# Altium schematic sheet GridSeed Old.SchDoc (part 2 of 2)
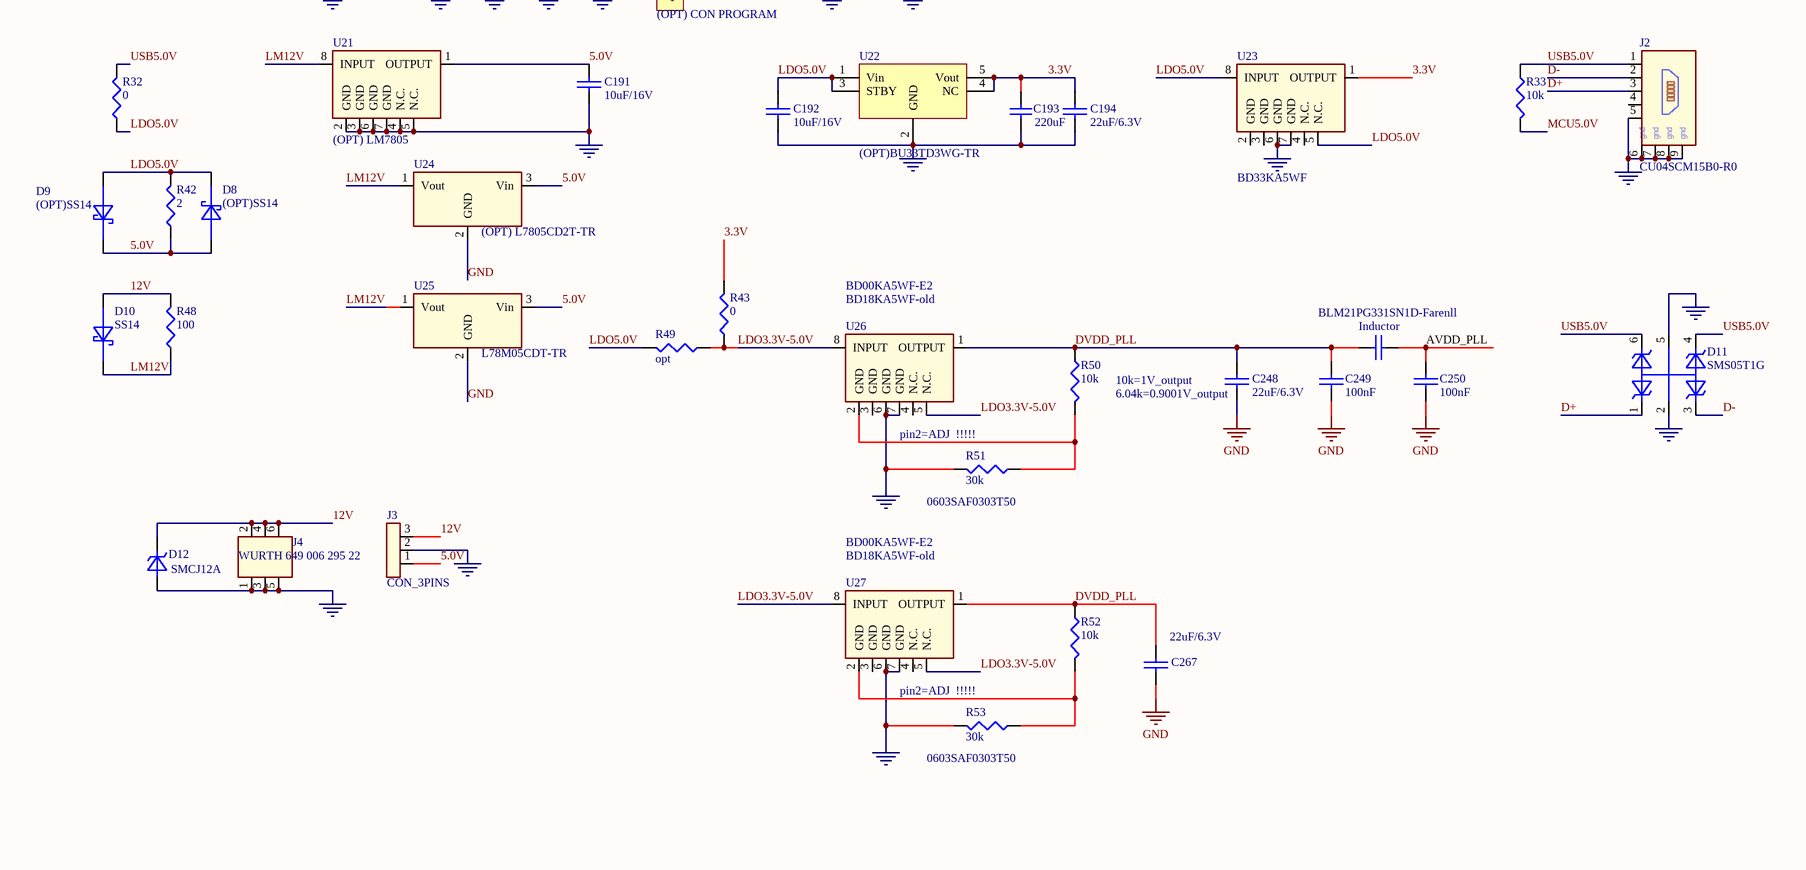
[diagram p6: GridSeed Old.SchDoc, bottom right]

## Nets
CHIP10_ID0: C1.1 C2.1 C3.1 C4.2 C5.2 C6.2 C10.2 C11.2 C12.2 C13.2 C14.2 C15.2 C16.2 C17.2 C18.2 C19.2 C20.2 C21.2 C22.2 C23.2 C24.2 C25.2 C26.2 C27.2 C28.2 C29.2 C30.2 C31.2 C32.2 C33.2 C34.2 C35.2 C36.2 C37.2 C38.2 C39.2 C40.2 C41.2 C42.2 C43.2 C44.2 C45.2 C46.2 C47.2 C48.2 C49.2 C50.2 C51.2 C52.2 C53.2 C54.2 C55.2 C56.2 C57.2 C58.2 C59.2 C60.2 C61.2 C62.2 C63.2 C64.2 C65.2 C66.2 C67.2 C68.2 C69.2 C70.2 C71.2 C72.2 C73.2 C74.2 C75.2 C76.2 C77.2 C78.2 C79.2 C80.2 C81.2 C82.2 C83.2 C84.2 C85.2 C86.2 C87.2 C88.2 C89.2 C90.2 C91.2 C92.2 C93.2 C94.2 C95.2 C96.2 C97.2 C98.2 C99.2 C100.2 C101.2 C102.2 C103.2 C104.2 C105.2 C106.2 C107.2 C108.2 C109.2 C110.2 C111.2 C112.2 C113.2 C114.2 C115.2 C116.2 C117.2 C118.2 C119.2 C120.2 C121.2 C122.2 C123.2 C124.2 C125.2 C126.2 C127.2 C128.2 C129.2 C130.2 C131.2 C132.2 C133.2 C134.2 C135.2 C136.2 C137.2 C138.2 C139.2 C140.2 C141.2 C142.2 C143.2 C144.2 C145.2 C146.2 C147.2 C148.2 C149.2 C150.2 C151.2 C152.2 C153.2 C154.2 C155.2 C156.2 C157.2 C158.2 C159.2 C160.2 C161.2 C162.2 C163.2 C164.2 C165.2 C166.2 C167.2 C168.2 C169.2 C170.2 C171.2 C172.2 C173.2 C174.2 C175.2 C176.2 C177.2 C178.2 C179.2 C180.2 C181.2 C182.2 C183.2 C184.2 C185.2 C186.2 C187.2 C188.2 C189.2 C190.2 C191.2 C192.2 C193.2 C194.2 C195.2 C196.2 C197.2 C198.2 C199.2 C200.2 C201.2 C202.2 C203.2 C204.2 C205.2 C206.2 C207.2 C208.2 C209.2 C210.2 C211.2 C212.2 C213.2 C214.2 C215.2 C216.2 C217.2 C218.2 C219.2 C220.2 C221.2 C222.2 C223.2 C224.2 C225.2 C226.2 C227.2 C228.2 C229.2 C230.2 C231.2 C232.2 C233.2 C234.2 C235.2 C236.2 C237.2 C238.2 C239.2 C240.2 C241.2 C242.2 C243.2 C244.2 C245.2 C246.2 C248.2 C249.2 C250.2 C251.2 C252.2 C253.2 C254.2 C255.2 C256.2 C257.2 C258.2 C259.2 C260.2 C261.2 C262.2 C263.2 C264.2 C265.2 C266.2 C267.2 C268.2 C269.2 C270.2 C271.2 C272.2 C273.2 C274.2 C275.2 C276.2 C277.2 C278.2 C279.2 C280.2 C281.2 C282.2 C283.2 C284.2 C285.2 C286.2 C287.2 C288.2 C289.2 C290.2 C291.2 C292.2 C293.2 C294.2 C295.2 C296.2 C297.2 C298.2 C299.2 C300.2 C301.2 C302.2 C303.2 C304.2 C305.2 C306.2 C307.2 C308.2 C309.2 C310.2 C311.2 C312.2 C313.2 C314.2 C315.2 C316.2 C317.2 C318.2 C319.2 C320.2 C321.2 C322.2 C323.2 C324.2 C325.2 C326.2 C327.2 C328.2 C329.2 C330.2 C331.2 C332.2 C333.2 C334.2 C335.2 C336.2 C337.2 C338.2 C339.2 C340.2 C341.2 C342.2 C343.2 C344.2 C345.2 C346.2 C347.2 C348.2 C349.2 C350.2 C351.2 C352.2 C353.2 C354.2 C355.2 C356.2 C357.2 C358.2 C359.2 C360.2 C361.2 C362.2 C363.2 C364.2 C365.2 C366.2 C367.2 C368.2 C369.2 C370.2 C371.2 C372.2 C373.2 C374.2 C375.2 C376.2 C377.2 C378.2 C379.2 C380.2 C381.2 C382.2 C383.2 C384.2 C385.2 C386.2 C387.2 C388.2 C389.2 C390.2 C391.2 C392.2 C393.2 C394.2 C395.2 C396.2 C397.2 C398.2 C399.2 C400.2 C401.2 C402.2 C403.2 C404.2 C405.2 C406.2 C407.2 C408.2 C409.2 C410.2 C411.2 C412.2 C413.2 C414.2 C415.2 C416.2 C_1.2 C_2.2 C_3.2 C_4.2 C_5.2 C_6.2 C_7.2 C_8.2 C_9.2 C_10.2 C_11.2 C_12.2 C_13.2 C_14.2 C_15.2 C_16.2 C_17.2 C_18.2 C_19.2 C_20.2 C_21.2 C_22.2 C_23.2 C_24.2 C_25.2 C_26.2 C_27.2 C_28.2 C_29.2 C_30.2 C_31.2 C_32.2 C_33.2 C_34.2 C_35.2 C_36.2 C_37.2 C_38.2 C_39.2 C_40.2 C_41.2 C_42.2 C_43.2 C_44.2 C_45.2 C_46.2 C_47.2 C_48.2 C_49.2 C_50.2 C_51.2 C_52.2 C_53.2 C_54.2 C_55.2 C_56.2 C_57.2 C_58.2 C_59.2 C_60.2 C_61.2 C_62.2 C_63.2 C_64.2 C_65.2 C_66.2 C_67.2 C_68.2 C_69.2 C_70.2 C_71.2 C_72.2 D4.1(C) D5.1(C) D6.1(C) D7.1(C) D11.2(AAAA) D11.5(C4) D12.2(A) J1.3 J2.5 J2.6 J2.7 J2.8 J2.9 J3.2 J4.1 J4.3 J4.5 Q4.1(S) Q4.2(S) Q4.3(S) Q5.1(S) Q5.2(S) Q5.3(S) Q6.1(S) Q6.2(S) Q6.3(S) Q7.1(S) Q7.2(S) Q7.3(S) Q8.1(S) Q8.2(S) Q8.3(S) Q9.1(S) Q9.2(S) Q9.3(S) R1.1 R2.1 R3.1 R4.1 R17.1 R18.1 R19.1 R20.1 R21.2 R22.2 R23.2 R25.1 R28.2 R44.1 R45.1 R46.1 R47.1 R51.2 R53.2 R64.1 R65.1 R66.1 R67.1 U1.7(VSSA_PLL) U1.10(VSS_PLL) U1.15(DVSS) U1.16(CHIP_ID0) U1.17(CHIP_ID1) U1.18(CHIP_ID2) U1.28(DVSS) U1.31(OVSS1) U1.33(DVSS) U1.36(DVSS) U1.40(DVSS) U1.44(DVSS) U1.50(OVSS0) U1.53(DVSS) U1.61(DVSS) U1.64(DVSS) U1.65(DVSS_EP) U2.7(VSSA_PLL) U2.10(VSS_PLL) U2.15(DVSS) U2.16(CHIP_ID0) U2.17(CHIP_ID1) U2.28(DVSS) U2.31(OVSS1) U2.33(DVSS) U2.36(DVSS) U2.40(DVSS) U2.44(DVSS) U2.50(OVSS0) U2.53(DVSS) U2.61(DVSS) U2.64(DVSS) U2.65(DVSS_EP) U3.7(VSSA_PLL) U3.10(VSS_PLL) U3.15(DVSS) U3.16(CHIP_ID0) U3.18(CHIP_ID2) U3.28(DVSS) U3.31(OVSS1) U3.33(DVSS) U3.36(DVSS) U3.40(DVSS) U3.44(DVSS) U3.50(OVSS0) U3.53(DVSS) U3.61(DVSS) U3.64(DVSS) U3.65(DVSS_EP) U4.7(VSSA_PLL) U4.10(VSS_PLL) U4.15(DVSS) U4.16(CHIP_ID0) U4.28(DVSS) U4.31(OVSS1) U4.33(DVSS) U4.36(DVSS) U4.40(DVSS) U4.44(DVSS) U4.50(OVSS0) U4.53(DVSS) U4.61(DVSS) U4.64(DVSS) U4.65(DVSS_EP) U5.7(VSSA_PLL) U5.10(VSS_PLL) U5.15(DVSS) U5.17(CHIP_ID1) U5.18(CHIP_ID2) U5.28(DVSS) U5.31(OVSS1) U5.33(DVSS) U5.36(DVSS) U5.40(DVSS) U5.44(DVSS) U5.50(OVSS0) U5.53(DVSS) U5.61(DVSS) U5.64(DVSS) U5.65(DVSS_EP) U6.7(VSSA_PLL) U6.10(VSS_PLL) U6.15(DVSS) U6.17(CHIP_ID1) U6.28(DVSS) U6.31(OVSS1) U6.33(DVSS) U6.36(DVSS) U6.40(DVSS) U6.44(DVSS) U6.50(OVSS0) U6.53(DVSS) U6.61(DVSS) U6.64(DVSS) U6.65(DVSS_EP) U7.7(VSSA_PLL) U7.10(VSS_PLL) U7.15(DVSS) U7.18(CHIP_ID2) U7.28(DVSS) U7.31(OVSS1) U7.33(DVSS) U7.36(DVSS) U7.40(DVSS) U7.44(DVSS) U7.50(OVSS0) U7.53(DVSS) U7.61(DVSS) U7.64(DVSS) U7.65(DVSS_EP) U8.7(VSSA_PLL) U8.10(VSS_PLL) U8.15(DVSS) U8.28(DVSS) U8.31(OVSS1) U8.33(DVSS) U8.36(DVSS) U8.40(DVSS) U8.44(DVSS) U8.50(OVSS0) U8.53(DVSS) U8.61(DVSS) U8.64(DVSS) U8.65(DVSS_EP) U9.7(VSSA_PLL) U9.10(VSS_PLL) U9.15(DVSS) U9.16(CHIP_ID0) U9.17(CHIP_ID1) U9.18(CHIP_ID2) U9.28(DVSS) U9.31(OVSS1) U9.33(DVSS) U9.36(DVSS) U9.40(DVSS) U9.44(DVSS) U9.50(OVSS0) U9.53(DVSS) U9.61(DVSS) U9.64(DVSS) U9.65(DVSS_EP) U10.7(VSSA_PLL) U10.10(VSS_PLL) U10.15(DVSS) U10.16(CHIP_ID0) U10.17(CHIP_ID1) U10.28(DVSS) U10.31(OVSS1) U10.33(DVSS) U10.36(DVSS) U10.40(DVSS) U10.44(DVSS) U10.50(OVSS0) U10.53(DVSS) U10.61(DVSS) U10.64(DVSS) U10.65(DVSS_EP) U11.7(VSSA_PLL) U11.10(VSS_PLL) U11.15(DVSS) U11.16(CHIP_ID0) U11.18(CHIP_ID2) U11.28(DVSS) U11.31(OVSS1) U11.33(DVSS) U11.36(DVSS) U11.40(DVSS) U11.44(DVSS) U11.50(OVSS0) U11.53(DVSS) U11.61(DVSS) U11.64(DVSS) U11.65(DVSS_EP) U12.7(VSSA_PLL) U12.10(VSS_PLL) U12.15(DVSS) U12.16(CHIP_ID0) U12.28(DVSS) U12.31(OVSS1) U12.33(DVSS) U12.36(DVSS) U12.40(DVSS) U12.44(DVSS) U12.50(OVSS0) U12.53(DVSS) U12.61(DVSS) U12.64(DVSS) U12.65(DVSS_EP) U13.7(VSSA_PLL) U13.10(VSS_PLL) U13.15(DVSS) U13.17(CHIP_ID1) U13.18(CHIP_ID2) U13.28(DVSS) U13.31(OVSS1) U13.33(DVSS) U13.36(DVSS) U13.40(DVSS) U13.44(DVSS) U13.50(OVSS0) U13.53(DVSS) U13.61(DVSS) U13.64(DVSS) U13.65(DVSS_EP) U14.7(VSSA_PLL) U14.10(VSS_PLL) U14.15(DVSS) U14.17(CHIP_ID1) U14.28(DVSS) U14.31(OVSS1) U14.33(DVSS) U14.36(DVSS) U14.40(DVSS) U14.44(DVSS) U14.50(OVSS0) U14.53(DVSS) U14.61(DVSS) U14.64(DVSS) U14.65(DVSS_EP) U15.7(VSSA_PLL) U15.10(VSS_PLL) U15.15(DVSS) U15.18(CHIP_ID2) U15.28(DVSS) U15.31(OVSS1) U15.33(DVSS) U15.36(DVSS) U15.40(DVSS) U15.44(DVSS) U15.50(OVSS0) U15.53(DVSS) U15.61(DVSS) U15.64(DVSS) U15.65(DVSS_EP) U16.7(VSSA_PLL) U16.10(VSS_PLL) U16.15(DVSS) U16.28(DVSS) U16.31(OVSS1) U16.33(DVSS) U16.36(DVSS) U16.40(DVSS) U16.44(DVSS) U16.50(OVSS0) U16.53(DVSS) U16.61(DVSS) U16.64(DVSS) U16.65(DVSS_EP) U17.4(GND) U17.9(EP) U18.4(GND) U18.9(EP) U19.4(GND) U19.9(EP) U20.9(VSS) U20.20(AVSS) U20.25(VSS) U20.41(VSS) U21.2(GND) U21.3(GND) U21.4(N.C.) U21.5(N.C.) U21.6(GND) U21.7(GND) U22.2(GND) U23.6(GND) U23.7(GND) U24.2(GND) U25.2(GND) U26.6(GND) U26.7(GND) U27.6(GND) U27.7(GND)  [also labelled CHIP10_ID1, CHIP11_ID0, CHIP11_ID2, CHIP12_ID0, CHIP13_ID1, CHIP13_ID2, CHIP14_ID1, CHIP15_ID2, CHIP1_ID0, CHIP1_ID1, CHIP1_ID2, CHIP2_ID0, CHIP2_ID1, CHIP3_ID0, CHIP3_ID2, CHIP4_ID0, CHIP5_ID1, CHIP5_ID2, CHIP6_ID1, CHIP7_ID2, CHIP9_ID0, CHIP9_ID1, CHIP9_ID2, GND]
1V: C12.1 C13.1 C14.1 C17.1 C18.1 C19.1 C22.1 C23.1 C24.1 C25.1 C26.1 C28.1 C29.1 C30.1 C32.1 C33.1 C34.1 C36.1 C37.1 C38.1 C40.1 C45.1 C46.1 C47.1 C48.1 C49.1 C50.1 C51.1 C52.1 C53.1 C54.1 C55.1 C56.1 C57.1 C58.1 C59.1 C60.1 C61.1 C62.1 C63.1 C64.1 C65.1 C66.1 C67.1 C68.1 C70.1 C72.1 C74.1 C76.1 C78.1 C79.1 C80.1 C81.1 C82.1 C83.1 C84.1 C85.1 C118.1 C119.1 C121.1 C122.1 C123.1 C125.1 C126.1 C127.1 C129.1 C130.1 C131.1 C133.1 C140.1 C141.1 C142.1 C143.1 C144.1 C145.1 C146.1 C147.1 C148.1 C149.1 C150.1 C151.1 C153.1 C154.1 C155.1 C156.1 C157.1 C158.1 C159.1 C160.1 C161.1 C162.1 C163.1 C164.1 C175.1 C177.1 C179.1 C181.1 C183.1 C184.1 C185.1 C186.1 C187.1 C188.1 C189.1 C190.1 C227.1 C228.1 C230.1 C231.1 C232.1 C234.1 C235.1 C236.1 C238.1 C239.1 C240.1 C242.1 C251.1 C252.1 C253.1 C254.1 C255.1 C256.1 C257.1 C258.1 C259.1 C260.1 C261.1 C262.1 C263.1 C264.1 C265.1 C266.1 C268.1 C269.1 C270.1 C271.1 C272.1 C273.1 C274.1 C275.1 C277.1 C279.1 C281.1 C283.1 C285.1 C286.1 C287.1 C288.1 C289.1 C290.1 C291.1 C292.1 C325.1 C326.1 C328.1 C329.1 C330.1 C332.1 C333.1 C334.1 C336.1 C337.1 C338.1 C340.1 C345.1 C346.1 C347.1 C348.1 C349.1 C350.1 C351.1 C352.1 C353.1 C354.1 C355.1 C356.1 C357.1 C358.1 C359.1 C360.1 C361.1 C362.1 C363.1 C364.1 C365.1 C366.1 C367.1 C368.1 C369.1 C371.1 C373.1 C375.1 C377.1 C378.1 C379.1 C380.1 C381.1 C382.1 C383.1 C384.1 C_1.1 C_2.1 C_3.1 C_4.1 C_5.1 C_6.1 C_7.1 C_8.1 C_9.1 C_10.1 C_11.1 C_12.1 C_13.1 C_14.1 C_15.1 C_16.1 C_17.1 C_18.1 C_19.1 C_20.1 C_21.1 C_22.1 C_23.1 C_24.1 C_25.1 C_26.1 C_27.1 C_28.1 C_29.1 C_30.1 C_31.1 C_32.1 C_33.1 C_34.1 C_35.1 C_36.1 C_37.1 C_38.1 C_39.1 C_40.1 C_41.1 C_42.1 C_43.1 C_44.1 C_45.1 C_46.1 C_47.1 C_48.1 C_49.1 C_50.1 C_51.1 C_52.1 C_53.1 C_54.1 C_55.1 C_56.1 C_57.1 C_58.1 C_59.1 C_60.1 C_61.1 C_62.1 C_63.1 C_64.1 C_65.1 C_66.1 C_67.1 C_68.1 C_69.1 C_70.1 C_71.1 C_72.1 L1.2 L2.2 L3.2 R27.2 R29.2 R30.2 U1.3(DVDD) U1.4(DVDD) U1.5(DVDD) U1.6(DVDD) U1.13(DVDD) U1.14(DVDD) U1.19(DVDD) U1.20(DVDD) U1.21(DVDD) U1.22(DVDD) U1.26(DVDD) U1.27(DVDD) U1.29(DVDD) U1.30(DVDD) U1.34(DVDD) U1.35(DVDD) U1.37(DVDD) U1.38(DVDD) U1.39(DVDD) U1.41(DVDD) U1.42(DVDD) U1.43(DVDD) U1.45(DVDD) U1.46(DVDD) U1.51(DVDD) U1.52(DVDD) U1.54(DVDD) U1.55(DVDD) U1.58(DVDD) U1.59(DVDD) U1.60(DVDD) U1.62(DVDD) U1.63(DVDD) U2.3(DVDD) U2.4(DVDD) U2.5(DVDD) U2.6(DVDD) U2.13(DVDD) U2.14(DVDD) U2.19(DVDD) U2.20(DVDD) U2.21(DVDD) U2.22(DVDD) U2.26(DVDD) U2.27(DVDD) U2.29(DVDD) U2.30(DVDD) U2.34(DVDD) U2.35(DVDD) U2.37(DVDD) U2.38(DVDD) U2.39(DVDD) U2.41(DVDD) U2.42(DVDD) U2.43(DVDD) U2.45(DVDD) U2.46(DVDD) U2.51(DVDD) U2.52(DVDD) U2.54(DVDD) U2.55(DVDD) U2.58(DVDD) U2.59(DVDD) U2.60(DVDD) U2.62(DVDD) U2.63(DVDD) U3.3(DVDD) U3.4(DVDD) U3.5(DVDD) U3.6(DVDD) U3.13(DVDD) U3.14(DVDD) U3.19(DVDD) U3.20(DVDD) U3.21(DVDD) U3.22(DVDD) U3.26(DVDD) U3.27(DVDD) U3.29(DVDD) U3.30(DVDD) U3.34(DVDD) U3.35(DVDD) U3.37(DVDD) U3.38(DVDD) U3.39(DVDD) U3.41(DVDD) U3.42(DVDD) U3.43(DVDD) U3.45(DVDD) U3.46(DVDD) U3.51(DVDD) U3.52(DVDD) U3.54(DVDD) U3.55(DVDD) U3.58(DVDD) U3.59(DVDD) U3.60(DVDD) U3.62(DVDD) U3.63(DVDD) U4.3(DVDD) U4.4(DVDD) U4.5(DVDD) U4.6(DVDD) U4.13(DVDD) U4.14(DVDD) U4.19(DVDD) U4.20(DVDD) U4.21(DVDD) U4.22(DVDD) U4.26(DVDD) U4.27(DVDD) U4.29(DVDD) U4.30(DVDD) U4.34(DVDD) U4.35(DVDD) U4.37(DVDD) U4.38(DVDD) U4.39(DVDD) U4.41(DVDD) U4.42(DVDD) U4.43(DVDD) U4.45(DVDD) U4.46(DVDD) U4.51(DVDD) U4.52(DVDD) U4.54(DVDD) U4.55(DVDD) U4.58(DVDD) U4.59(DVDD) U4.60(DVDD) U4.62(DVDD) U4.63(DVDD) U5.3(DVDD) U5.4(DVDD) U5.5(DVDD) U5.6(DVDD) U5.13(DVDD) U5.14(DVDD) U5.19(DVDD) U5.20(DVDD) U5.21(DVDD) U5.22(DVDD) U5.26(DVDD) U5.27(DVDD) U5.29(DVDD) U5.30(DVDD) U5.34(DVDD) U5.35(DVDD) U5.37(DVDD) U5.38(DVDD) U5.39(DVDD) U5.41(DVDD) U5.42(DVDD) U5.43(DVDD) U5.45(DVDD) U5.46(DVDD) U5.51(DVDD) U5.52(DVDD) U5.54(DVDD) U5.55(DVDD) U5.58(DVDD) U5.59(DVDD) U5.60(DVDD) U5.62(DVDD) U5.63(DVDD) U6.3(DVDD) U6.4(DVDD) U6.5(DVDD) U6.6(DVDD) U6.13(DVDD) U6.14(DVDD) U6.19(DVDD) U6.20(DVDD) U6.21(DVDD) U6.22(DVDD) U6.26(DVDD) U6.27(DVDD) U6.29(DVDD) U6.30(DVDD) U6.34(DVDD) U6.35(DVDD) U6.37(DVDD) U6.38(DVDD) U6.39(DVDD) U6.41(DVDD) U6.42(DVDD) U6.43(DVDD) U6.45(DVDD) U6.46(DVDD) U6.51(DVDD) U6.52(DVDD) U6.54(DVDD) U6.55(DVDD) U6.58(DVDD) U6.59(DVDD) U6.60(DVDD) U6.62(DVDD) U6.63(DVDD) U7.3(DVDD) U7.4(DVDD) U7.5(DVDD) U7.6(DVDD) U7.13(DVDD) U7.14(DVDD) U7.19(DVDD) U7.20(DVDD) U7.21(DVDD) U7.22(DVDD) U7.26(DVDD) U7.27(DVDD) U7.29(DVDD) U7.30(DVDD) U7.34(DVDD) U7.35(DVDD) U7.37(DVDD) U7.38(DVDD) U7.39(DVDD) U7.41(DVDD) U7.42(DVDD) U7.43(DVDD) U7.45(DVDD) U7.46(DVDD) U7.51(DVDD) U7.52(DVDD) U7.54(DVDD) U7.55(DVDD) U7.58(DVDD) U7.59(DVDD) U7.60(DVDD) U7.62(DVDD) U7.63(DVDD) U8.3(DVDD) U8.4(DVDD) U8.5(DVDD) U8.6(DVDD) U8.13(DVDD) U8.14(DVDD) U8.19(DVDD) U8.20(DVDD) U8.21(DVDD) U8.22(DVDD) U8.26(DVDD) U8.27(DVDD) U8.29(DVDD) U8.30(DVDD) U8.34(DVDD) U8.35(DVDD) U8.37(DVDD) U8.38(DVDD) U8.39(DVDD) U8.41(DVDD) U8.42(DVDD) U8.43(DVDD) U8.45(DVDD) U8.46(DVDD) U8.51(DVDD) U8.52(DVDD) U8.54(DVDD) U8.55(DVDD) U8.58(DVDD) U8.59(DVDD) U8.60(DVDD) U8.62(DVDD) U8.63(DVDD) U9.3(DVDD) U9.4(DVDD) U9.5(DVDD) U9.6(DVDD) U9.13(DVDD) U9.14(DVDD) U9.19(DVDD) U9.20(DVDD) U9.21(DVDD) U9.22(DVDD) U9.26(DVDD) U9.27(DVDD) U9.29(DVDD) U9.30(DVDD) U9.34(DVDD) U9.35(DVDD) U9.37(DVDD) U9.38(DVDD) U9.39(DVDD) U9.41(DVDD) U9.42(DVDD) U9.43(DVDD) U9.45(DVDD) U9.46(DVDD) U9.51(DVDD) U9.52(DVDD) U9.54(DVDD) U9.55(DVDD) U9.58(DVDD) U9.59(DVDD) U9.60(DVDD) U9.62(DVDD) U9.63(DVDD) U10.3(DVDD) U10.4(DVDD) U10.5(DVDD) U10.6(DVDD) U10.13(DVDD) U10.14(DVDD) U10.19(DVDD) U10.20(DVDD) U10.21(DVDD) U10.22(DVDD) U10.26(DVDD) U10.27(DVDD) U10.29(DVDD) U10.30(DVDD) U10.34(DVDD) U10.35(DVDD) U10.37(DVDD) U10.38(DVDD) U10.39(DVDD) U10.41(DVDD) U10.42(DVDD) U10.43(DVDD) U10.45(DVDD) U10.46(DVDD) U10.51(DVDD) U10.52(DVDD) U10.54(DVDD) U10.55(DVDD) U10.58(DVDD) U10.59(DVDD) U10.60(DVDD) U10.62(DVDD) U10.63(DVDD) U11.3(DVDD) U11.4(DVDD) U11.5(DVDD) U11.6(DVDD) U11.13(DVDD) U11.14(DVDD) U11.19(DVDD) U11.20(DVDD) U11.21(DVDD) U11.22(DVDD) U11.26(DVDD) U11.27(DVDD) U11.29(DVDD) U11.30(DVDD) U11.34(DVDD) U11.35(DVDD) U11.37(DVDD) U11.38(DVDD) U11.39(DVDD) U11.41(DVDD) U11.42(DVDD) U11.43(DVDD) U11.45(DVDD) U11.46(DVDD) U11.51(DVDD) U11.52(DVDD) U11.54(DVDD) U11.55(DVDD) U11.58(DVDD) U11.59(DVDD) U11.60(DVDD) U11.62(DVDD) U11.63(DVDD) U12.3(DVDD) U12.4(DVDD) U12.5(DVDD) U12.6(DVDD) U12.13(DVDD) U12.14(DVDD) U12.19(DVDD) U12.20(DVDD) U12.21(DVDD) U12.22(DVDD) U12.26(DVDD) U12.27(DVDD) U12.29(DVDD) U12.30(DVDD) U12.34(DVDD) U12.35(DVDD) U12.37(DVDD) U12.38(DVDD) U12.39(DVDD) U12.41(DVDD) U12.42(DVDD) U12.43(DVDD) U12.45(DVDD) U12.46(DVDD) U12.51(DVDD) U12.52(DVDD) U12.54(DVDD) U12.55(DVDD) U12.58(DVDD) U12.59(DVDD) U12.60(DVDD) U12.62(DVDD) U12.63(DVDD) U13.3(DVDD) U13.4(DVDD) U13.5(DVDD) U13.6(DVDD) U13.13(DVDD) U13.14(DVDD) U13.19(DVDD) U13.20(DVDD) U13.21(DVDD) U13.22(DVDD) U13.26(DVDD) U13.27(DVDD) U13.29(DVDD) U13.30(DVDD) U13.34(DVDD) U13.35(DVDD) U13.37(DVDD) U13.38(DVDD) U13.39(DVDD) U13.41(DVDD) U13.42(DVDD) U13.43(DVDD) U13.45(DVDD) U13.46(DVDD) U13.51(DVDD) U13.52(DVDD) U13.54(DVDD) U13.55(DVDD) U13.58(DVDD) U13.59(DVDD) U13.60(DVDD) U13.62(DVDD) U13.63(DVDD) U14.3(DVDD) U14.4(DVDD) U14.5(DVDD) U14.6(DVDD) U14.13(DVDD) U14.14(DVDD) U14.19(DVDD) U14.20(DVDD) U14.21(DVDD) U14.22(DVDD) U14.26(DVDD) U14.27(DVDD) U14.29(DVDD) U14.30(DVDD) U14.34(DVDD) U14.35(DVDD) U14.37(DVDD) U14.38(DVDD) U14.39(DVDD) U14.41(DVDD) U14.42(DVDD) U14.43(DVDD) U14.45(DVDD) U14.46(DVDD) U14.51(DVDD) U14.52(DVDD) U14.54(DVDD) U14.55(DVDD) U14.58(DVDD) U14.59(DVDD) U14.60(DVDD) U14.62(DVDD) U14.63(DVDD) U15.3(DVDD) U15.4(DVDD) U15.5(DVDD) U15.6(DVDD) U15.13(DVDD) U15.14(DVDD) U15.19(DVDD) U15.20(DVDD) U15.21(DVDD) U15.22(DVDD) U15.26(DVDD) U15.27(DVDD) U15.29(DVDD) U15.30(DVDD) U15.34(DVDD) U15.35(DVDD) U15.37(DVDD) U15.38(DVDD) U15.39(DVDD) U15.41(DVDD) U15.42(DVDD) U15.43(DVDD) U15.45(DVDD) U15.46(DVDD) U15.51(DVDD) U15.52(DVDD) U15.54(DVDD) U15.55(DVDD) U15.58(DVDD) U15.59(DVDD) U15.60(DVDD) U15.62(DVDD) U15.63(DVDD) U16.3(DVDD) U16.4(DVDD) U16.5(DVDD) U16.6(DVDD) U16.13(DVDD) U16.14(DVDD) U16.19(DVDD) U16.20(DVDD) U16.21(DVDD) U16.22(DVDD) U16.26(DVDD) U16.27(DVDD) U16.29(DVDD) U16.30(DVDD) U16.34(DVDD) U16.35(DVDD) U16.37(DVDD) U16.38(DVDD) U16.39(DVDD) U16.41(DVDD) U16.42(DVDD) U16.43(DVDD) U16.45(DVDD) U16.46(DVDD) U16.51(DVDD) U16.52(DVDD) U16.54(DVDD) U16.55(DVDD) U16.58(DVDD) U16.59(DVDD) U16.60(DVDD) U16.62(DVDD) U16.63(DVDD)
3.3V: C41.1 C42.1 C43.1 C44.1 C69.1 C71.1 C73.1 C75.1 C77.1 C134.1 C135.1 C136.1 C137.1 C165.1 C169.1 C170.1 C171.1 C172.1 C176.1 C178.1 C180.1 C182.1 C193.1 C194.1 C243.1 C244.1 C245.1 C246.1 C276.1 C278.1 C280.1 C282.1 C284.1 C341.1 C342.1 C343.1 C344.1 C370.1 C372.1 C374.1 C376.1 J1.2 R5.2 R6.2 R7.2 R8.1 R31.2 R43.2 R54.2 R55.1 U1.32(OVDD1) U1.49(OVDD0) U2.18(CHIP_ID2) U2.32(OVDD1) U2.49(OVDD0) U3.17(CHIP_ID1) U3.32(OVDD1) U3.49(OVDD0) U4.17(CHIP_ID1) U4.18(CHIP_ID2) U4.32(OVDD1) U4.49(OVDD0) U5.16(CHIP_ID0) U5.32(OVDD1) U5.49(OVDD0) U6.16(CHIP_ID0) U6.18(CHIP_ID2) U6.32(OVDD1) U6.49(OVDD0) U7.16(CHIP_ID0) U7.17(CHIP_ID1) U7.32(OVDD1) U7.49(OVDD0) U8.16(CHIP_ID0) U8.17(CHIP_ID1) U8.18(CHIP_ID2) U8.32(OVDD1) U8.49(OVDD0) U9.32(OVDD1) U9.49(OVDD0) U10.18(CHIP_ID2) U10.32(OVDD1) U10.49(OVDD0) U11.17(CHIP_ID1) U11.32(OVDD1) U11.49(OVDD0) U12.17(CHIP_ID1) U12.18(CHIP_ID2) U12.32(OVDD1) U12.49(OVDD0) U13.16(CHIP_ID0) U13.32(OVDD1) U13.49(OVDD0) U14.16(CHIP_ID0) U14.18(CHIP_ID2) U14.32(OVDD1) U14.49(OVDD0) U15.16(CHIP_ID0) U15.17(CHIP_ID1) U15.32(OVDD1) U15.49(OVDD0) U16.16(CHIP_ID0) U16.17(CHIP_ID1) U16.18(CHIP_ID2) U16.32(OVDD1) U16.49(OVDD0) U20.10(VDD) U20.19(AVDD) U20.26(VDD) U20.35(VUSB3V3) U20.38(VDD) U20.57(VDD) U22.4(NC) U22.5(Vout) U23.1(OUTPUT)  [also labelled CHIP10_ID2, CHIP11_ID1, CHIP12_ID1, CHIP12_ID2, CHIP13_ID0, CHIP14_ID0, CHIP14_ID2, CHIP15_ID0, CHIP15_ID1, CHIP16_ID0, CHIP16_ID1, CHIP16_ID2, CHIP2_ID2, CHIP3_ID1, CHIP4_ID1, CHIP4_ID2, CHIP5_ID0, CHIP6_ID0, CHIP6_ID2, CHIP7_ID0, CHIP7_ID1, CHIP8_ID0, CHIP8_ID1, CHIP8_ID2]
5.0V: C1.2 C2.2 C3.2 C191.1 D1.1(A1) D1.2(A2) D2.1(A1) D2.2(A2) D3.1(A1) D3.2(A2) D8.2(A) D9.1(C) J3.1 R42.1 U17.7(VCC) U18.7(VCC) U19.7(VCC) U21.1(OUTPUT) U24.3(Vin) U25.3(Vin)
12V: C10.1 C11.1 C15.1 C16.1 C20.1 C21.1 D10.2(A) D12.1(C) J3.3 J4.2 J4.4 J4.6 Q1.5(D) Q1.6(D) Q1.7(D) Q1.8(D) Q2.5(D) Q2.6(D) Q2.7(D) Q2.8(D) Q3.5(D) Q3.6(D) Q3.7(D) Q3.8(D) R24.1 R48.2
ASIC_RESET_MCU: C27.1 C31.1 C35.1 C39.1 C120.1 C124.1 C128.1 C132.1 C229.1 C233.1 C237.1 C241.1 C327.1 C331.1 C335.1 C339.1 R5.1 U1.57(RSTN) U2.57(RSTN) U3.57(RSTN) U4.57(RSTN) U5.57(RSTN) U6.57(RSTN) U7.57(RSTN) U8.57(RSTN) U9.57(RSTN) U10.57(RSTN) U11.57(RSTN) U12.57(RSTN) U13.57(RSTN) U14.57(RSTN) U15.57(RSTN) U16.57(RSTN) U20.5(C1IN1-/SDI2/PMA4/RPI119/RG7)
AVDD_PLL: C247.2 C250.1 R10.2 R12.2 R14.2 R16.2 R35.2 R37.2 R39.2 R41.2 R57.2 R59.2 R61.2 R63.2 R69.2 R71.2 R73.2 R75.2
BOOT1: C7.1 D1.3(CC) U17.8(BOOT)
BOOT2: C8.1 D2.3(CC) U18.8(BOOT)
BOOT3: C9.1 D3.3(CC) U19.8(BOOT)
CompFB+: C166.1 R29.1 U20.11(AN5/C1IN1+/VBUSON/VBUSST/RPI37/RB5)
CompFB-: C167.1 R30.1 U20.12(AN4/C1IN2-/USBOEN/RPI36/RB4)
CORE_CLKOUT_1: R1.2 U1.56(CORE_CLKOUT)
CORE_CLKOUT_2: R2.2 U2.56(CORE_CLKOUT)
CORE_CLKOUT_3: R3.2 U3.56(CORE_CLKOUT)
CORE_CLKOUT_4: R4.2 U4.56(CORE_CLKOUT)
CORE_CLKOUT_5: R17.2 U5.56(CORE_CLKOUT)
CORE_CLKOUT_6: R18.2 U6.56(CORE_CLKOUT)
CORE_CLKOUT_7: R19.2 U7.56(CORE_CLKOUT)
CORE_CLKOUT_8: R20.2 U8.56(CORE_CLKOUT)
CORE_CLKOUT_9: R44.2 U9.56(CORE_CLKOUT)
CORE_CLKOUT_10: R45.2 U10.56(CORE_CLKOUT)
CORE_CLKOUT_11: R46.2 U11.56(CORE_CLKOUT)
CORE_CLKOUT_12: R47.2 U12.56(CORE_CLKOUT)
CORE_CLKOUT_13: R64.2 U13.56(CORE_CLKOUT)
CORE_CLKOUT_14: R65.2 U14.56(CORE_CLKOUT)
CORE_CLKOUT_15: R66.2 U15.56(CORE_CLKOUT)
CORE_CLKOUT_16: R67.2 U16.56(CORE_CLKOUT)
D+: D11.1(C1) J2.3 U20.37(D+/RG2)
D-: D11.3(C2) J2.2 U20.36(D-/RG3)
DRVLogic: C4.1 C5.1 C6.1 U17.6(Vlogic) U18.6(Vlogic) U19.6(Vlogic) U20.55(C3IN1+/VCMPST3/RP71/RD7)
DVDD_PLL: C247.1 C248.1 C249.1 C267.1 R9.2 R11.2 R13.2 R15.2 R34.2 R36.2 R38.2 R40.2 R50.1 R52.1 R56.2 R58.2 R60.2 R62.2 R68.2 R70.2 R72.2 R74.2 U26.1(OUTPUT) U27.1(OUTPUT)
FB: C152.1 R27.1 U20.17(PGEC1/AN6/RPI38/RB6)
GREEN: D5.2(A) U20.47(PGED2/SOSCI/C3IN3-/RPI61/RC13)
HO1: Q1.4(G) U17.1(HO)
HO2: Q2.4(G) U18.1(HO)
HO3: Q3.4(G) U19.1(HO)
LDO3.3V-5.0V: R43.1 R49.1 U26.5(N.C.) U26.8(INPUT) U27.5(N.C.) U27.8(INPUT)
LDO5.0V: C192.1 D8.1(C) D9.2(A) R32.1 R42.2 R49.2 U22.1(Vin) U22.3(STBY) U23.5(N.C.) U23.8(INPUT)
LM12V: D10.1(C) R48.1 U21.8(INPUT) U24.1(Vout) U25.1(Vout)
LO1: Q4.4(G) Q5.4(G) U17.3(LO)
LO2: Q6.4(G) Q7.4(G) U18.3(LO)
LO3: Q8.4(G) Q9.4(G) U19.3(LO)
LTC_EN: R6.1 U1.47(LTC_EN) U2.47(LTC_EN) U3.47(LTC_EN) U4.47(LTC_EN) U5.47(LTC_EN) U6.47(LTC_EN) U7.47(LTC_EN) U8.47(LTC_EN) U9.47(LTC_EN) U10.47(LTC_EN) U11.47(LTC_EN) U12.47(LTC_EN) U13.47(LTC_EN) U14.47(LTC_EN) U15.47(LTC_EN) U16.47(LTC_EN) U20.23(TMS/AN10/CVREF/PMA13/RPI42/RB10)
Main OSC In: C173.1 U20.39(OSC1/RPI60/RC12) Y1.1
Main OSC Out: C174.1 U20.40(OSC2/CLKO/RC15) Y1.2
MCLR: C168.1 J1.1 R31.1 U20.7(MCLR)
MCU5.0V: R33.2 U20.34(VBUS)
MEAS12: C139.1 R24.2 R25.2 U20.18(PGED1/AN7/RCV/RPI39/RB7)
ORANGE: D7.2(A) U20.45(PMCS1/RPI75/RD11)
PGC: J1.5 U20.15(PGEC3/AN1/VREF-/RPI33/RB1)
PGD: J1.4 U20.16(PGED3/AN0/VREF+/RPI32/RB0)
PWM2H: R22.1 U18.5(IN) U20.63(AN27/PWM2H/PMD3/RPI83/RE3)
PWM2L: R23.1 U17.5(IN) U20.62(AN26/PWM2L/PMD2/RP82/RE2)
PWM3L: R21.1 U19.5(IN) U20.64(AN28/PWM3L/PMD4/RP84/RE4)
RED: D4.2(A) U20.48(PGEC2/SOSCO/C3IN1-/T1CK/RPI62/RC14)
RX_BTC_0: U1.1(CFG_P) U2.1(CFG_P) U3.1(CFG_P) U4.1(CFG_P) U5.1(CFG_P) U6.1(CFG_P) U7.1(CFG_P) U8.1(CFG_P) U20.59(VCMPST2/RP97/RF1)
RX_BTC_1: U9.1(CFG_P) U10.1(CFG_P) U11.1(CFG_P) U12.1(CFG_P) U13.1(CFG_P) U14.1(CFG_P) U15.1(CFG_P) U16.1(CFG_P) U20.3(AN31/PWM4H/PMD7/RP87/RE7)
RX_LTC_0: U1.2(CFG_N) U2.2(CFG_N) U3.2(CFG_N) U4.2(CFG_N) U5.2(CFG_N) U6.2(CFG_N) U7.2(CFG_N) U8.2(CFG_N) U20.58(VCMPST1/RP96/RF0)
RX_LTC_1: U9.2(CFG_N) U10.2(CFG_N) U11.2(CFG_N) U12.2(CFG_N) U13.2(CFG_N) U14.2(CFG_N) U15.2(CFG_N) U16.2(CFG_N) U20.4(C1IN3-/SCK2/PMA5/RP118/RG6)
SWN1: C7.2 L1.1 Q1.1(S) Q1.2(S) Q1.3(S) Q4.5(D) Q4.6(D) Q4.7(D) Q4.8(D) Q5.5(D) Q5.6(D) Q5.7(D) Q5.8(D) U17.2(SW)
SWN2: C8.2 L2.1 Q2.1(S) Q2.2(S) Q2.3(S) Q6.5(D) Q6.6(D) Q6.7(D) Q6.8(D) Q7.5(D) Q7.6(D) Q7.7(D) Q7.8(D) U18.2(SW)
SWN3: C9.2 L3.1 Q3.1(S) Q3.2(S) Q3.3(S) Q8.5(D) Q8.6(D) Q8.7(D) Q8.8(D) Q9.5(D) Q9.6(D) Q9.7(D) Q9.8(D) U19.2(SW)
TP1: U20.6(C2IN3-/SDO2/PMA3/RP120/RG8)
TP2: U20.8(C2IN1-/PMA2/RPI121/RG9)
TP3: U20.21(AN8/PMA6/RPI40/RB8)
TP4: U20.22(AN9/PMA7//RPI41/RB9)
TP5: U20.24(TDO/AN11/PMA12/RPI43/RB11)
TP6: U20.27(TCK/AN12/PMA11/RPI44/RB12)
TP7: U20.28(TDI/AN13/PMA10/RPI45/RB13)
TP8: U20.29(AN14/PMA1/RPI46/RB14)
TP9: U20.30(AN15/PMA0/RPI47/RB15)
TP10: U20.31(SDA2/PMA9/RP100/RF4)
TP11: U20.32(SCL2/PMA8/RP101/RF5)
TP12: U20.33(USBID/RP99/RF3)
TP13: U20.42(RTCC/DMLN/RPI72/RD8)
TP14: U20.43(ASDA1/DPLN/RPI73/RD9)
TP15: U20.50(DPH/RP66/RD2)
TP16: U20.51(PMBE/RP67/RD3)
TP17: U20.54(C3IN2-/RP70/RD6)
TP18: U20.14(AN2/C2IN2-/VMIO/RPI34/RB2)
TP19: U20.13(AN3/C2IN1+/VPIO/RPI35/RB3)
TP1011: U1.25(RPT_BUSYN)
TP1012: U2.25(RPT_BUSYN)
TP1013: U3.25(RPT_BUSYN)
TP1014: U4.25(RPT_BUSYN)
TP1015: U5.25(RPT_BUSYN)
TP1016: U6.25(RPT_BUSYN)
TP1017: U7.25(RPT_BUSYN)
TP1018: U8.25(RPT_BUSYN)
TP1019: U9.25(RPT_BUSYN)
TP10110: U10.25(RPT_BUSYN)
TP10111: U11.25(RPT_BUSYN)
TP10112: U12.25(RPT_BUSYN)
TP10113: U13.25(RPT_BUSYN)
TP10114: U14.25(RPT_BUSYN)
TP10115: U15.25(RPT_BUSYN)
TP10116: U16.25(RPT_BUSYN)
TP_1001: U1.48(LTC_BUSYN)
TP_1002: U2.48(LTC_BUSYN)
TP_1003: U3.48(LTC_BUSYN)
TP_1004: U4.48(LTC_BUSYN)
TP_1005: U5.48(LTC_BUSYN)
TP_1006: U6.48(LTC_BUSYN)
TP_1007: U7.48(LTC_BUSYN)
TP_1008: U8.48(LTC_BUSYN)
TP_1009: U9.48(LTC_BUSYN)
TP_10010: U10.48(LTC_BUSYN)
TP_10011: U11.48(LTC_BUSYN)
TP_10012: U12.48(LTC_BUSYN)
TP_10013: U13.48(LTC_BUSYN)
TP_10014: U14.48(LTC_BUSYN)
TP_10015: U15.48(LTC_BUSYN)
TP_10016: U16.48(LTC_BUSYN)
TX_BTC_0: R7.1 U1.24(RPT_P) U2.24(RPT_P) U3.24(RPT_P) U4.24(RPT_P) U5.24(RPT_P) U6.24(RPT_P) U7.24(RPT_P) U8.24(RPT_P) U20.61(AN25/PWM1H/PMD1/RPI81/RE1)
TX_BTC_1: R54.1 U9.24(RPT_P) U10.24(RPT_P) U11.24(RPT_P) U12.24(RPT_P) U13.24(RPT_P) U14.24(RPT_P) U15.24(RPT_P) U16.24(RPT_P) U20.1(AN29/PWM3H/PMD5/RP85/RE5)
TX_LTC_0: R8.2 U1.23(RPT_N) U2.23(RPT_N) U3.23(RPT_N) U4.23(RPT_N) U5.23(RPT_N) U6.23(RPT_N) U7.23(RPT_N) U8.23(RPT_N) U20.60(AN24/PWM1L/PMD0/RP80/RE0)
TX_LTC_1: R55.2 U9.23(RPT_N) U10.23(RPT_N) U11.23(RPT_N) U12.23(RPT_N) U13.23(RPT_N) U14.23(RPT_N) U15.23(RPT_N) U16.23(RPT_N) U20.2(AN30/PWM4L/PMD6/RPI86/RE6)
USB5.0V: D11.4(C3) D11.6(C4) J2.1 R32.2 R33.1
VCAP: C138.1 U20.56(VCAP)
VDD_PLL_1: C86.1 C87.1 C88.1 C89.1 R9.1 U1.9(VDD_PLL)
VDD_PLL_2: C94.1 C95.1 C96.1 C97.1 R11.1 U2.9(VDD_PLL)
VDD_PLL_3: C102.1 C103.1 C104.1 C105.1 R13.1 U3.9(VDD_PLL)
VDD_PLL_4: C110.1 C111.1 C112.1 C113.1 R15.1 U4.9(VDD_PLL)
VDD_PLL_5: C195.1 C196.1 C197.1 C198.1 R34.1 U5.9(VDD_PLL)
VDD_PLL_6: C203.1 C204.1 C205.1 C206.1 R36.1 U6.9(VDD_PLL)
VDD_PLL_7: C211.1 C212.1 C213.1 C214.1 R38.1 U7.9(VDD_PLL)
VDD_PLL_8: C219.1 C220.1 C221.1 C222.1 R40.1 U8.9(VDD_PLL)
VDD_PLL_9: C293.1 C294.1 C295.1 C296.1 R56.1 U9.9(VDD_PLL)
VDD_PLL_10: C301.1 C302.1 C303.1 C304.1 R58.1 U10.9(VDD_PLL)
VDD_PLL_11: C309.1 C310.1 C311.1 C312.1 R60.1 U11.9(VDD_PLL)
VDD_PLL_12: C317.1 C318.1 C319.1 C320.1 R62.1 U12.9(VDD_PLL)
VDD_PLL_13: C385.1 C386.1 C387.1 C388.1 R68.1 U13.9(VDD_PLL)
VDD_PLL_14: C393.1 C394.1 C395.1 C396.1 R70.1 U14.9(VDD_PLL)
VDD_PLL_15: C401.1 C402.1 C403.1 C404.1 R72.1 U15.9(VDD_PLL)
VDD_PLL_16: C409.1 C410.1 C411.1 C412.1 R74.1 U16.9(VDD_PLL)
VDDA_PLL_1: C90.1 C91.1 C92.1 C93.1 R10.1 U1.8(VDDA_PLL)
VDDA_PLL_2: C98.1 C99.1 C100.1 C101.1 R12.1 U2.8(VDDA_PLL)
VDDA_PLL_3: C106.1 C107.1 C108.1 C109.1 R14.1 U3.8(VDDA_PLL)
VDDA_PLL_4: C114.1 C115.1 C116.1 C117.1 R16.1 U4.8(VDDA_PLL)
VDDA_PLL_5: C199.1 C200.1 C201.1 C202.1 R35.1 U5.8(VDDA_PLL)
VDDA_PLL_6: C207.1 C208.1 C209.1 C210.1 R37.1 U6.8(VDDA_PLL)
VDDA_PLL_7: C215.1 C216.1 C217.1 C218.1 R39.1 U7.8(VDDA_PLL)
VDDA_PLL_8: C223.1 C224.1 C225.1 C226.1 R41.1 U8.8(VDDA_PLL)
VDDA_PLL_9: C297.1 C298.1 C299.1 C300.1 R57.1 U9.8(VDDA_PLL)
VDDA_PLL_10: C305.1 C306.1 C307.1 C308.1 R59.1 U10.8(VDDA_PLL)
VDDA_PLL_11: C313.1 C314.1 C315.1 C316.1 R61.1 U11.8(VDDA_PLL)
VDDA_PLL_12: C321.1 C322.1 C323.1 C324.1 R63.1 U12.8(VDDA_PLL)
VDDA_PLL_13: C389.1 C390.1 C391.1 C392.1 R69.1 U13.8(VDDA_PLL)
VDDA_PLL_14: C397.1 C398.1 C399.1 C400.1 R71.1 U14.8(VDDA_PLL)
VDDA_PLL_15: C405.1 C406.1 C407.1 C408.1 R73.1 U15.8(VDDA_PLL)
VDDA_PLL_16: C413.1 C414.1 C415.1 C416.1 R75.1 U16.8(VDDA_PLL)
XCLK1: R26.2 U20.46(INT0/DMH/RP64/RD0) U20.49(VCPCON/RP65/RD1) U20.52(PMWR/RP68/RD4) U20.53(PMRD/RP69/RD5)
XCLKIN: R26.1 R28.1 U1.11(XCLKIN)
XCLKOUT_1: U1.12(XCLKOUT) U2.11(XCLKIN)
XCLKOUT_2: U2.12(XCLKOUT) U3.11(XCLKIN)
XCLKOUT_3: U3.12(XCLKOUT) U4.11(XCLKIN)
XCLKOUT_4: U4.12(XCLKOUT) U5.11(XCLKIN)
XCLKOUT_5: U5.12(XCLKOUT) U6.11(XCLKIN)
XCLKOUT_6: U6.12(XCLKOUT) U7.11(XCLKIN)
XCLKOUT_7: U7.12(XCLKOUT) U8.11(XCLKIN)
XCLKOUT_8: U8.12(XCLKOUT) U9.11(XCLKIN)
XCLKOUT_9: U9.12(XCLKOUT) U10.11(XCLKIN)
XCLKOUT_10: U10.12(XCLKOUT) U11.11(XCLKIN)
XCLKOUT_11: U11.12(XCLKOUT) U12.11(XCLKIN)
XCLKOUT_12: U12.12(XCLKOUT) U13.11(XCLKIN)
XCLKOUT_13: U13.12(XCLKOUT) U14.11(XCLKIN)
XCLKOUT_14: U14.12(XCLKOUT) U15.11(XCLKIN)
XCLKOUT_15: U15.12(XCLKOUT) U16.11(XCLKIN)
XCLKOUT_16: U16.12(XCLKOUT)
YELLOW: D6.2(A) U20.44(ASCL1/PMCS2/RPI74/RD10)
NetR50_2: R50.2 R51.1 U26.2(GND)
NetR52_2: R52.2 R53.1 U27.2(GND)

Not connected (* = marked no-connect by the designer): J2 4; U23 2(GND) 3(GND) 4(N.C.); U26 3(GND) 4(N.C.); U27 3(GND) 4(N.C.)

## Notes on the sheet
- PD: GC3355 UART mode
- 0
- (near U1) 0
- (near U2) 1
- 1
- (near U3) 0
- (near U4) 1
- 0603SAJ010JT50
- close to pin 9 and 10
- (near C93) close to pin 7 and 8
- (near C101) close to pin 7 and 8
- (near C109) close to pin 7 and 8
- (near C117) close to pin 7 and 8
- CL21A225KPFNNNG
- CL21C101JBNC
- CL21C470JBNC
- CL21C220JBNC
- (near U5) 0
- (near U6) 1
- (near U7) 0
- (near C202) close to pin 7 and 8
- (near C210) close to pin 7 and 8
- (near C218) close to pin 7 and 8
- (near C226) close to pin 7 and 8
- BD00KA5WF-E2
- (near C247) BLM21PG331SN1D-Farenll
- 10k=1V_output
- (near C248) 6.04k=0.9001V_output
- pin2=ADJ  !!!!!
- (near R51) 0603SAF0303T50
- (near U9) 0
- (near U10) 1
- (near R53) 0603SAF0303T50
- (near C300) close to pin 7 and 8
- (near C308) close to pin 7 and 8
- (near C316) close to pin 7 and 8
- (near C324) close to pin 7 and 8
- (near C392) close to pin 7 and 8
- (near C400) close to pin 7 and 8
- (near C408) close to pin 7 and 8
- (near C416) close to pin 7 and 8
- Labels drawn without touching a wire or pin: 3.3V
- (in symbol CON_USB_MINI_1) gnd

## Library data of the parts
C1-C9 C69 C86-C117 C138 C139 C152 C165-C174 C191 C192 C194-C226 C247-C250 C267 C276 C293-C324 C385-C416 = CAP: Capacitor
  C152 C166 C167: Manufacturer PN: *
C10-C24 C193 C_1-C_72 = Cap Semi: CL32A227MQVNNNE 220UF 6.3V 20% X5R 1210; Published: 8-Jun-2000; LatestRevisionDate: 29-May-2009; LatestRevisionNote: IPC-7351 Footprint Added.; PackageReference: C1206; Publisher: Altium Limited; PackageDescription: Chip Capacitor
  C10 C11 C15 C16 C20 C21: Value: 100uF
  C12-C14 C17-C19 C22-C24 C193: Value: 220uF
  C_1-C_72: Value: (OPT)220uF
C25-C68 C70-C85 C118-C137 C140-C151 C153-C164 C175-C190 C227-C246 C251-C266 C268-C275 C277-C292 C325-C384 = Cap Semi: Capacitor (Semiconductor SIM Model); Published: 8-Jun-2000; LatestRevisionDate: 29-May-2009; LatestRevisionNote: IPC-7351 Footprint Added.; PackageReference: C1206; Publisher: Altium Limited; PackageDescription: Chip Capacitor; Value: 470nF; Manufacturer PN: *
D1-D3 = D_DUAL_A1A2CC3: NOTE: <NOTE>
D4-D7 = LED_2: NOTE: <NOTE>
D8-D10 = D_STKY: NOTE: <NOTE>
D11 = D_TVS_QUAD_C1AA2AA5C3C4C6: 4 IO lines TVS; NOTE: <NOTE>
D12 = D_TVS_UNI: Еднопосочен трансил, 600W, UBRmin13.3V@1mA; NOTE: <NOTE>
J1 = CON5: Connector
J2 = CON_USB_MINI_1: NOTE: <NOTE>
J4 = CON_PCI-E: 4.20mm Male Dual Row Angled Header WR-MPC4
L1-L3 = L
Q1-Q9 = MOS_N_D1_S1S2S3G4D5D6D7D8: NOTE: <NOTE>
R1-R75 = Res3: Resistor; Published: 8-Jun-2000; LatestRevisionDate: 29-May-2009; LatestRevisionNote: IPC-7351 Footprint Added.; PackageReference: J1-0603; Publisher: Altium Limited; PackageDescription: Chip Resistor
  R1-R8 R17-R24 R29-R31 R33 R44-R47 R50 R52 R54 R55 R64-R67: Value: 10k
  R9-R16 R34-R41 R56-R63 R68-R75: Value: 1
  R25: Value: 2.4k
  R26 R28: Value: 47
  R27: Value: 10k; Manufacturer PN: *
  R32 R43: Value: 0
  R42: Value: 2
  R48: Value: 100
  R49: Value: opt
  R51 R53: Value: 30k
U1-U16 = GC3355Q64: GridSeed
U17-U19 = DRVFET_LTC4442: Mosfet 12V Dual Bootstrapped PWM Sync Buck Optimised
U21 U23 = IC_LM2931AD-5.0R2G_SO-8
U22 = VOLTREG LDO
U24 U25 = IC_Vout1GND2Vin3: NOTE: <NOTE>
U26 U27 = IC_LM2931AD-5.0R2G_SO-8: to be replaced by BD00KA5WF-E2
Y1 = CRYSTAL